# EAGLE schematic Resistor_Resistor (EAGLE 8.3.0), part 9 of 43
## Parts (continued)
R11658  10K  RESISTOR_0201  [0201]
R11659  10K  RESISTOR_0201  [0201]
R11660  10K  RESISTOR_0201  [0201]
R11661  10K  RESISTOR_0201  [0201]
R11662  10K  RESISTOR_0201  [0201]
R11663  10K  RESISTOR_0201  [0201]
R11664  10K  RESISTOR_0201  [0201]
R11665  10K  RESISTOR_0201  [0201]
R11666  10K  RESISTOR_0201  [0201]
R11667  10K  RESISTOR_0201  [0201]
R11668  10K  RESISTOR_0201  [0201]
R11669  10K  RESISTOR_0201  [0201]
R11670  10K  RESISTOR_0201  [0201]
R11671  10K  RESISTOR_0201  [0201]
R11672  10K  RESISTOR_0201  [0201]
R11673  10K  RESISTOR_0201  [0201]
R11674  10K  RESISTOR_0201  [0201]
R11675  10K  RESISTOR_0201  [0201]
R11676  10K  RESISTOR_0201  [0201]
R11677  10K  RESISTOR_0201  [0201]
R11678  10K  RESISTOR_0201  [0201]
R11679  10K  RESISTOR_0201  [0201]
R11680  10K  RESISTOR_0201  [0201]
R11681  10K  RESISTOR_0201  [0201]
R11682  10K  RESISTOR_0201  [0201]
R11683  10K  RESISTOR_0201  [0201]
R11684  10K  RESISTOR_0201  [0201]
R11685  10K  RESISTOR_0201  [0201]
R11686  10K  RESISTOR_0201  [0201]
R11687  10K  RESISTOR_0201  [0201]
R11688  10K  RESISTOR_0201  [0201]
R11689  10K  RESISTOR_0201  [0201]
R11690  10K  RESISTOR_0201  [0201]
R11691  10K  RESISTOR_0201  [0201]
R11692  10K  RESISTOR_0201  [0201]
R11693  10K  RESISTOR_0201  [0201]
R11694  10K  RESISTOR_0201  [0201]
R11695  10K  RESISTOR_0201  [0201]
R11696  10K  RESISTOR_0201  [0201]
R11697  10K  RESISTOR_0201  [0201]
R11698  10K  RESISTOR_0201  [0201]
R11699  10K  RESISTOR_0201  [0201]
R11700  10K  RESISTOR_0201  [0201]
R11701  10K  RESISTOR_0201  [0201]
R11702  10K  RESISTOR_0201  [0201]
R11703  10K  RESISTOR_0201  [0201]
R11704  10K  RESISTOR_0201  [0201]
R11705  10K  RESISTOR_0201  [0201]
R11706  10K  RESISTOR_0201  [0201]
R11707  10K  RESISTOR_0201  [0201]
R11708  10K  RESISTOR_0201  [0201]
R11709  10K  RESISTOR_0201  [0201]
R11710  10K  RESISTOR_0201  [0201]
R11711  10K  RESISTOR_0201  [0201]
R11712  10K  RESISTOR_0201  [0201]
R11713  10K  RESISTOR_0201  [0201]
R11714  10K  RESISTOR_0201  [0201]
R11715  10K  RESISTOR_0201  [0201]
R11716  10K  RESISTOR_0201  [0201]
R11717  10K  RESISTOR_0201  [0201]
R11718  10K  RESISTOR_0201  [0201]
R11719  10K  RESISTOR_0201  [0201]
R11720  10K  RESISTOR_0201  [0201]
R11721  10K  RESISTOR_0201  [0201]
R11722  10K  RESISTOR_0201  [0201]
R11723  10K  RESISTOR_0201  [0201]
R11724  10K  RESISTOR_0201  [0201]
R11725  10K  RESISTOR_0201  [0201]
R11726  10K  RESISTOR_0201  [0201]
R11727  10K  RESISTOR_0201  [0201]
R11728  10K  RESISTOR_0201  [0201]
R11729  10K  RESISTOR_0201  [0201]
R11730  10K  RESISTOR_0201  [0201]
R11731  10K  RESISTOR_0201  [0201]
R11732  10K  RESISTOR_0201  [0201]
R11733  10K  RESISTOR_0201  [0201]
R11734  10K  RESISTOR_0201  [0201]
R11735  10K  RESISTOR_0201  [0201]
R11736  10K  RESISTOR_0201  [0201]
R11737  10K  RESISTOR_0201  [0201]
R11738  10K  RESISTOR_0201  [0201]
R11739  10K  RESISTOR_0201  [0201]
R11740  10K  RESISTOR_0201  [0201]
R11741  10K  RESISTOR_0201  [0201]
R11742  10K  RESISTOR_0201  [0201]
R11743  10K  RESISTOR_0201  [0201]
R11744  10K  RESISTOR_0201  [0201]
R11745  10K  RESISTOR_0201  [0201]
R11746  10K  RESISTOR_0201  [0201]
R11747  10K  RESISTOR_0201  [0201]
R11748  10K  RESISTOR_0201  [0201]
R11749  10K  RESISTOR_0201  [0201]
R11750  10K  RESISTOR_0201  [0201]
R11751  10K  RESISTOR_0201  [0201]
R11752  10K  RESISTOR_0201  [0201]
R11753  10K  RESISTOR_0201  [0201]
R11754  10K  RESISTOR_0201  [0201]
R11755  10K  RESISTOR_0201  [0201]
R11756  10K  RESISTOR_0201  [0201]
R11757  10K  RESISTOR_0201  [0201]
R11758  10K  RESISTOR_0201  [0201]
R11759  10K  RESISTOR_0201  [0201]
R11760  10K  RESISTOR_0201  [0201]
R11761  10K  RESISTOR_0201  [0201]
R11762  10K  RESISTOR_0201  [0201]
R11763  10K  RESISTOR_0201  [0201]
R11764  10K  RESISTOR_0201  [0201]
R11765  10K  RESISTOR_0201  [0201]
R11766  10K  RESISTOR_0201  [0201]
R11767  10K  RESISTOR_0201  [0201]
R11768  10K  RESISTOR_0201  [0201]
R11769  10K  RESISTOR_0201  [0201]
R11770  10K  RESISTOR_0201  [0201]
R11771  10K  RESISTOR_0201  [0201]
R11772  10K  RESISTOR_0201  [0201]
R11773  10K  RESISTOR_0201  [0201]
R11774  10K  RESISTOR_0201  [0201]
R11775  10K  RESISTOR_0201  [0201]
R11776  10K  RESISTOR_0201  [0201]
R11777  10K  RESISTOR_0201  [0201]
R11778  10K  RESISTOR_0201  [0201]
R11779  10K  RESISTOR_0201  [0201]
R11780  10K  RESISTOR_0201  [0201]
R11781  10K  RESISTOR_0201  [0201]
R11782  10K  RESISTOR_0201  [0201]
R11783  10K  RESISTOR_0201  [0201]
R11784  10K  RESISTOR_0201  [0201]
R11785  10K  RESISTOR_0201  [0201]
R11786  10K  RESISTOR_0201  [0201]
R11787  10K  RESISTOR_0201  [0201]
R11788  10K  RESISTOR_0201  [0201]
R11789  10K  RESISTOR_0201  [0201]
R11790  10K  RESISTOR_0201  [0201]
R11791  10K  RESISTOR_0201  [0201]
R11792  10K  RESISTOR_0201  [0201]
R11793  10K  RESISTOR_0201  [0201]
R11794  10K  RESISTOR_0201  [0201]
R11795  10K  RESISTOR_0201  [0201]
R11796  10K  RESISTOR_0201  [0201]
R11797  10K  RESISTOR_0201  [0201]
R11798  10K  RESISTOR_0201  [0201]
R11799  10K  RESISTOR_0201  [0201]
R11800  10K  RESISTOR_0201  [0201]
R11801  10K  RESISTOR_0201  [0201]
R11802  10K  RESISTOR_0201  [0201]
R11803  10K  RESISTOR_0201  [0201]
R11804  10K  RESISTOR_0201  [0201]
R11805  10K  RESISTOR_0201  [0201]
R11806  10K  RESISTOR_0201  [0201]
R11807  10K  RESISTOR_0201  [0201]
R11808  10K  RESISTOR_0201  [0201]
R11809  10K  RESISTOR_0201  [0201]
R11810  10K  RESISTOR_0201  [0201]
R11811  10K  RESISTOR_0201  [0201]
R11812  10K  RESISTOR_0201  [0201]
R11813  10K  RESISTOR_0201  [0201]
R11814  10K  RESISTOR_0201  [0201]
R11815  10K  RESISTOR_0201  [0201]
R11816  10K  RESISTOR_0201  [0201]
R11817  10K  RESISTOR_0201  [0201]
R11818  10K  RESISTOR_0201  [0201]
R11819  10K  RESISTOR_0201  [0201]
R11820  10K  RESISTOR_0201  [0201]
R11821  10K  RESISTOR_0201  [0201]
R11822  10K  RESISTOR_0201  [0201]
R11823  10K  RESISTOR_0201  [0201]
R11824  10K  RESISTOR_0201  [0201]
R11825  10K  RESISTOR_0201  [0201]
R11826  10K  RESISTOR_0201  [0201]
R11827  10K  RESISTOR_0201  [0201]
R11828  10K  RESISTOR_0201  [0201]
R11829  10K  RESISTOR_0201  [0201]
R11830  10K  RESISTOR_0201  [0201]
R11831  10K  RESISTOR_0201  [0201]
R11832  10K  RESISTOR_0201  [0201]
R11833  10K  RESISTOR_0201  [0201]
R11834  10K  RESISTOR_0201  [0201]
R11835  10K  RESISTOR_0201  [0201]
R11836  10K  RESISTOR_0201  [0201]
R11837  10K  RESISTOR_0201  [0201]
R11838  10K  RESISTOR_0201  [0201]
R11839  10K  RESISTOR_0201  [0201]
R11840  10K  RESISTOR_0201  [0201]
R11841  10K  RESISTOR_0201  [0201]
R11842  10K  RESISTOR_0201  [0201]
R11843  10K  RESISTOR_0201  [0201]
R11844  10K  RESISTOR_0201  [0201]
R11845  10K  RESISTOR_0201  [0201]
R11846  10K  RESISTOR_0201  [0201]
R11847  10K  RESISTOR_0201  [0201]
R11848  10K  RESISTOR_0201  [0201]
R11849  10K  RESISTOR_0201  [0201]
R11850  10K  RESISTOR_0201  [0201]
R11851  10K  RESISTOR_0201  [0201]
R11852  10K  RESISTOR_0201  [0201]
R11853  10K  RESISTOR_0201  [0201]
R11854  10K  RESISTOR_0201  [0201]
R11855  10K  RESISTOR_0201  [0201]
R11856  10K  RESISTOR_0201  [0201]
R11857  10K  RESISTOR_0201  [0201]
R11858  10K  RESISTOR_0201  [0201]
R11859  10K  RESISTOR_0201  [0201]
R11860  10K  RESISTOR_0201  [0201]
R11861  10K  RESISTOR_0201  [0201]
R11862  10K  RESISTOR_0201  [0201]
R11863  10K  RESISTOR_0201  [0201]
R11864  10K  RESISTOR_0201  [0201]
R11865  10K  RESISTOR_0201  [0201]
R11866  10K  RESISTOR_0201  [0201]
R11867  10K  RESISTOR_0201  [0201]
R11868  10K  RESISTOR_0201  [0201]
R11869  10K  RESISTOR_0201  [0201]
R11870  10K  RESISTOR_0201  [0201]
R11871  10K  RESISTOR_0201  [0201]
R11872  10K  RESISTOR_0201  [0201]
R11873  10K  RESISTOR_0201  [0201]
R11874  10K  RESISTOR_0201  [0201]
R11875  10K  RESISTOR_0201  [0201]
R11876  10K  RESISTOR_0201  [0201]
R11877  10K  RESISTOR_0201  [0201]
R11878  10K  RESISTOR_0201  [0201]
R11879  10K  RESISTOR_0201  [0201]
R11880  10K  RESISTOR_0201  [0201]
R11881  10K  RESISTOR_0201  [0201]
R11882  10K  RESISTOR_0201  [0201]
R11883  10K  RESISTOR_0201  [0201]
R11884  10K  RESISTOR_0201  [0201]
R11885  10K  RESISTOR_0201  [0201]
R11886  10K  RESISTOR_0201  [0201]
R11887  10K  RESISTOR_0201  [0201]
R11888  10K  RESISTOR_0201  [0201]
R11889  10K  RESISTOR_0201  [0201]
R11890  10K  RESISTOR_0201  [0201]
R11891  10K  RESISTOR_0201  [0201]
R11892  10K  RESISTOR_0201  [0201]
R11893  10K  RESISTOR_0201  [0201]
R11894  10K  RESISTOR_0201  [0201]
R11895  10K  RESISTOR_0201  [0201]
R11896  10K  RESISTOR_0201  [0201]
R11897  10K  RESISTOR_0201  [0201]
R11898  10K  RESISTOR_0201  [0201]
R11899  10K  RESISTOR_0201  [0201]
R11900  10K  RESISTOR_0201  [0201]
R11901  10K  RESISTOR_0201  [0201]
R11902  10K  RESISTOR_0201  [0201]
R11903  10K  RESISTOR_0201  [0201]
R11904  10K  RESISTOR_0201  [0201]
R11905  10K  RESISTOR_0201  [0201]
R11906  10K  RESISTOR_0201  [0201]
R11907  10K  RESISTOR_0201  [0201]
R11908  10K  RESISTOR_0201  [0201]
R11909  10K  RESISTOR_0201  [0201]
R11910  10K  RESISTOR_0201  [0201]
R11911  10K  RESISTOR_0201  [0201]
R11912  10K  RESISTOR_0201  [0201]
R11913  10K  RESISTOR_0201  [0201]
R11914  10K  RESISTOR_0201  [0201]
R11915  10K  RESISTOR_0201  [0201]
R11916  10K  RESISTOR_0201  [0201]
R11917  10K  RESISTOR_0201  [0201]
R11918  10K  RESISTOR_0201  [0201]
R11919  10K  RESISTOR_0201  [0201]
R11920  10K  RESISTOR_0201  [0201]
R11921  10K  RESISTOR_0201  [0201]
R11922  10K  RESISTOR_0201  [0201]
R11923  10K  RESISTOR_0201  [0201]
R11924  10K  RESISTOR_0201  [0201]
R11925  10K  RESISTOR_0201  [0201]
R11926  10K  RESISTOR_0201  [0201]
R11927  10K  RESISTOR_0201  [0201]
R11928  10K  RESISTOR_0201  [0201]
R11929  10K  RESISTOR_0201  [0201]
R11930  10K  RESISTOR_0201  [0201]
R11931  10K  RESISTOR_0201  [0201]
R11932  10K  RESISTOR_0201  [0201]
R11933  10K  RESISTOR_0201  [0201]
R11934  10K  RESISTOR_0201  [0201]
R11935  10K  RESISTOR_0201  [0201]
R11936  10K  RESISTOR_0201  [0201]
R11937  10K  RESISTOR_0201  [0201]
R11938  10K  RESISTOR_0201  [0201]
R11939  10K  RESISTOR_0201  [0201]
R11940  10K  RESISTOR_0201  [0201]
R11941  10K  RESISTOR_0201  [0201]
R11942  10K  RESISTOR_0201  [0201]
R11943  10K  RESISTOR_0201  [0201]
R11944  10K  RESISTOR_0201  [0201]
R11945  10K  RESISTOR_0201  [0201]
R11946  10K  RESISTOR_0201  [0201]
R11947  10K  RESISTOR_0201  [0201]
R11948  10K  RESISTOR_0201  [0201]
R11949  10K  RESISTOR_0201  [0201]
R11950  10K  RESISTOR_0201  [0201]
R11951  10K  RESISTOR_0201  [0201]
R11952  10K  RESISTOR_0201  [0201]
R11953  10K  RESISTOR_0201  [0201]
R11954  10K  RESISTOR_0201  [0201]
R11955  10K  RESISTOR_0201  [0201]
R11956  10K  RESISTOR_0201  [0201]
R11957  10K  RESISTOR_0201  [0201]
R11958  10K  RESISTOR_0201  [0201]
R11959  10K  RESISTOR_0201  [0201]
R11960  10K  RESISTOR_0201  [0201]
R11961  10K  RESISTOR_0201  [0201]
R11962  10K  RESISTOR_0201  [0201]
R11963  10K  RESISTOR_0201  [0201]
R11964  10K  RESISTOR_0201  [0201]
R11965  10K  RESISTOR_0201  [0201]
R11966  10K  RESISTOR_0201  [0201]
R11967  10K  RESISTOR_0201  [0201]
R11968  10K  RESISTOR_0201  [0201]
R11969  10K  RESISTOR_0201  [0201]
R11970  10K  RESISTOR_0201  [0201]
R11971  10K  RESISTOR_0201  [0201]
R11972  10K  RESISTOR_0201  [0201]
R11973  10K  RESISTOR_0201  [0201]
R11974  10K  RESISTOR_0201  [0201]
R11975  10K  RESISTOR_0201  [0201]
R11976  10K  RESISTOR_0201  [0201]
R11977  10K  RESISTOR_0201  [0201]
R11978  10K  RESISTOR_0201  [0201]
R11979  10K  RESISTOR_0201  [0201]
R11980  10K  RESISTOR_0201  [0201]
R11981  10K  RESISTOR_0201  [0201]
R11982  10K  RESISTOR_0201  [0201]
R11983  10K  RESISTOR_0201  [0201]
R11984  10K  RESISTOR_0201  [0201]
R11985  10K  RESISTOR_0201  [0201]
R11986  10K  RESISTOR_0201  [0201]
R11987  10K  RESISTOR_0201  [0201]
R11988  10K  RESISTOR_0201  [0201]
R11989  10K  RESISTOR_0201  [0201]
R11990  10K  RESISTOR_0201  [0201]
R11991  10K  RESISTOR_0201  [0201]
R11992  10K  RESISTOR_0201  [0201]
R11993  10K  RESISTOR_0201  [0201]
R11994  10K  RESISTOR_0201  [0201]
R11995  10K  RESISTOR_0201  [0201]
R11996  10K  RESISTOR_0201  [0201]
R11997  10K  RESISTOR_0201  [0201]
R11998  10K  RESISTOR_0201  [0201]
R11999  10K  RESISTOR_0201  [0201]
R12000  10K  RESISTOR_0201  [0201]
R12001  10K  RESISTOR_0201  [0201]
R12002  10K  RESISTOR_0201  [0201]
R12003  10K  RESISTOR_0201  [0201]
R12004  10K  RESISTOR_0201  [0201]
R12005  10K  RESISTOR_0201  [0201]
R12006  10K  RESISTOR_0201  [0201]
R12007  10K  RESISTOR_0201  [0201]
R12008  10K  RESISTOR_0201  [0201]
R12009  10K  RESISTOR_0201  [0201]
R12010  10K  RESISTOR_0201  [0201]
R12011  10K  RESISTOR_0201  [0201]
R12012  10K  RESISTOR_0201  [0201]
R12013  10K  RESISTOR_0201  [0201]
R12014  10K  RESISTOR_0201  [0201]
R12015  10K  RESISTOR_0201  [0201]
R12016  10K  RESISTOR_0201  [0201]
R12017  10K  RESISTOR_0201  [0201]
R12018  10K  RESISTOR_0201  [0201]
R12019  10K  RESISTOR_0201  [0201]
R12020  10K  RESISTOR_0201  [0201]
R12021  10K  RESISTOR_0201  [0201]
R12022  10K  RESISTOR_0201  [0201]
R12023  10K  RESISTOR_0201  [0201]
R12024  10K  RESISTOR_0201  [0201]
R12025  10K  RESISTOR_0201  [0201]
R12026  10K  RESISTOR_0201  [0201]
R12027  10K  RESISTOR_0201  [0201]
R12028  10K  RESISTOR_0201  [0201]
R12029  10K  RESISTOR_0201  [0201]
R12030  10K  RESISTOR_0201  [0201]
R12031  10K  RESISTOR_0201  [0201]
R12032  10K  RESISTOR_0201  [0201]
R12033  10K  RESISTOR_0201  [0201]
R12034  10K  RESISTOR_0201  [0201]
R12035  10K  RESISTOR_0201  [0201]
R12036  10K  RESISTOR_0201  [0201]
R12037  10K  RESISTOR_0201  [0201]
R12038  10K  RESISTOR_0201  [0201]
R12039  10K  RESISTOR_0201  [0201]
R12040  10K  RESISTOR_0201  [0201]
R12041  10K  RESISTOR_0201  [0201]
R12042  10K  RESISTOR_0201  [0201]
R12043  10K  RESISTOR_0201  [0201]
R12044  10K  RESISTOR_0201  [0201]
R12045  10K  RESISTOR_0201  [0201]
R12046  10K  RESISTOR_0201  [0201]
R12047  10K  RESISTOR_0201  [0201]
R12048  10K  RESISTOR_0201  [0201]
R12049  10K  RESISTOR_0201  [0201]
R12050  10K  RESISTOR_0201  [0201]
R12051  10K  RESISTOR_0201  [0201]
R12052  10K  RESISTOR_0201  [0201]
R12053  10K  RESISTOR_0201  [0201]
R12054  10K  RESISTOR_0201  [0201]
R12055  10K  RESISTOR_0201  [0201]
R12056  10K  RESISTOR_0201  [0201]
R12057  10K  RESISTOR_0201  [0201]
R12058  10K  RESISTOR_0201  [0201]
R12059  10K  RESISTOR_0201  [0201]
R12060  10K  RESISTOR_0201  [0201]
R12061  10K  RESISTOR_0201  [0201]
R12062  10K  RESISTOR_0201  [0201]
R12063  10K  RESISTOR_0201  [0201]
R12064  10K  RESISTOR_0201  [0201]
R12065  10K  RESISTOR_0201  [0201]
R12066  10K  RESISTOR_0201  [0201]
R12067  10K  RESISTOR_0201  [0201]
R12068  10K  RESISTOR_0201  [0201]
R12069  10K  RESISTOR_0201  [0201]
R12070  10K  RESISTOR_0201  [0201]
R12071  10K  RESISTOR_0201  [0201]
R12072  10K  RESISTOR_0201  [0201]
R12073  10K  RESISTOR_0201  [0201]
R12074  10K  RESISTOR_0201  [0201]
R12075  10K  RESISTOR_0201  [0201]
R12076  10K  RESISTOR_0201  [0201]
R12077  10K  RESISTOR_0201  [0201]
R12078  10K  RESISTOR_0201  [0201]
R12079  10K  RESISTOR_0201  [0201]
R12080  10K  RESISTOR_0201  [0201]
R12081  10K  RESISTOR_0201  [0201]
R12082  10K  RESISTOR_0201  [0201]
R12083  10K  RESISTOR_0201  [0201]
R12084  10K  RESISTOR_0201  [0201]
R12085  10K  RESISTOR_0201  [0201]
R12086  10K  RESISTOR_0201  [0201]
R12087  10K  RESISTOR_0201  [0201]
R12088  10K  RESISTOR_0201  [0201]
R12089  10K  RESISTOR_0201  [0201]
R12090  10K  RESISTOR_0201  [0201]
R12091  10K  RESISTOR_0201  [0201]
R12092  10K  RESISTOR_0201  [0201]
R12093  10K  RESISTOR_0201  [0201]
R12094  10K  RESISTOR_0201  [0201]
R12095  10K  RESISTOR_0201  [0201]
R12096  10K  RESISTOR_0201  [0201]
R12097  10K  RESISTOR_0201  [0201]
R12098  10K  RESISTOR_0201  [0201]
R12099  10K  RESISTOR_0201  [0201]
R12100  10K  RESISTOR_0201  [0201]
R12101  10K  RESISTOR_0201  [0201]
R12102  10K  RESISTOR_0201  [0201]
R12103  10K  RESISTOR_0201  [0201]
R12104  10K  RESISTOR_0201  [0201]
R12105  10K  RESISTOR_0201  [0201]
R12106  10K  RESISTOR_0201  [0201]
R12107  10K  RESISTOR_0201  [0201]
R12108  10K  RESISTOR_0201  [0201]
R12109  10K  RESISTOR_0201  [0201]
R12110  10K  RESISTOR_0201  [0201]
R12111  10K  RESISTOR_0201  [0201]
R12112  10K  RESISTOR_0201  [0201]
R12113  10K  RESISTOR_0201  [0201]
R12114  10K  RESISTOR_0201  [0201]
R12115  10K  RESISTOR_0201  [0201]
R12116  10K  RESISTOR_0201  [0201]
R12117  10K  RESISTOR_0201  [0201]
R12118  10K  RESISTOR_0201  [0201]
R12119  10K  RESISTOR_0201  [0201]
R12120  10K  RESISTOR_0201  [0201]
R12121  10K  RESISTOR_0201  [0201]
R12122  10K  RESISTOR_0201  [0201]
R12123  10K  RESISTOR_0201  [0201]
R12124  10K  RESISTOR_0201  [0201]
R12125  10K  RESISTOR_0201  [0201]
R12126  10K  RESISTOR_0201  [0201]
R12127  10K  RESISTOR_0201  [0201]
R12128  10K  RESISTOR_0201  [0201]
R12129  10K  RESISTOR_0201  [0201]
R12130  10K  RESISTOR_0201  [0201]
R12131  10K  RESISTOR_0201  [0201]
R12132  10K  RESISTOR_0201  [0201]
R12133  10K  RESISTOR_0201  [0201]
R12134  10K  RESISTOR_0201  [0201]
R12135  10K  RESISTOR_0201  [0201]
R12136  10K  RESISTOR_0201  [0201]
R12137  10K  RESISTOR_0201  [0201]
R12138  10K  RESISTOR_0201  [0201]
R12139  10K  RESISTOR_0201  [0201]
R12140  10K  RESISTOR_0201  [0201]
R12141  10K  RESISTOR_0201  [0201]
R12142  10K  RESISTOR_0201  [0201]
R12143  10K  RESISTOR_0201  [0201]
R12144  10K  RESISTOR_0201  [0201]
R12145  10K  RESISTOR_0201  [0201]
R12146  10K  RESISTOR_0201  [0201]
R12147  10K  RESISTOR_0201  [0201]
R12148  10K  RESISTOR_0201  [0201]
R12149  10K  RESISTOR_0201  [0201]
R12150  10K  RESISTOR_0201  [0201]
R12151  10K  RESISTOR_0201  [0201]
R12152  10K  RESISTOR_0201  [0201]
R12153  10K  RESISTOR_0201  [0201]
R12154  10K  RESISTOR_0201  [0201]
R12155  10K  RESISTOR_0201  [0201]
R12156  10K  RESISTOR_0201  [0201]
R12157  10K  RESISTOR_0201  [0201]
R12158  10K  RESISTOR_0201  [0201]
R12159  10K  RESISTOR_0201  [0201]
R12160  10K  RESISTOR_0201  [0201]
R12161  10K  RESISTOR_0201  [0201]
R12162  10K  RESISTOR_0201  [0201]
R12163  10K  RESISTOR_0201  [0201]
R12164  10K  RESISTOR_0201  [0201]
R12165  10K  RESISTOR_0201  [0201]
R12166  10K  RESISTOR_0201  [0201]
R12167  10K  RESISTOR_0201  [0201]
R12168  10K  RESISTOR_0201  [0201]
R12169  10K  RESISTOR_0201  [0201]
R12170  10K  RESISTOR_0201  [0201]
R12171  10K  RESISTOR_0201  [0201]
R12172  10K  RESISTOR_0201  [0201]
R12173  10K  RESISTOR_0201  [0201]
R12174  10K  RESISTOR_0201  [0201]
R12175  10K  RESISTOR_0201  [0201]
R12176  10K  RESISTOR_0201  [0201]
R12177  10K  RESISTOR_0201  [0201]
R12178  10K  RESISTOR_0201  [0201]
R12179  10K  RESISTOR_0201  [0201]
R12180  10K  RESISTOR_0201  [0201]
R12181  10K  RESISTOR_0201  [0201]
R12182  10K  RESISTOR_0201  [0201]
R12183  10K  RESISTOR_0201  [0201]
R12184  10K  RESISTOR_0201  [0201]
R12185  10K  RESISTOR_0201  [0201]
R12186  10K  RESISTOR_0201  [0201]
R12187  10K  RESISTOR_0201  [0201]
R12188  10K  RESISTOR_0201  [0201]
R12189  10K  RESISTOR_0201  [0201]
R12190  10K  RESISTOR_0201  [0201]
R12191  10K  RESISTOR_0201  [0201]
R12192  10K  RESISTOR_0201  [0201]
R12193  10K  RESISTOR_0201  [0201]
R12194  10K  RESISTOR_0201  [0201]
R12195  10K  RESISTOR_0201  [0201]
R12196  10K  RESISTOR_0201  [0201]
R12197  10K  RESISTOR_0201  [0201]
R12198  10K  RESISTOR_0201  [0201]
R12199  10K  RESISTOR_0201  [0201]
R12200  10K  RESISTOR_0201  [0201]
R12201  10K  RESISTOR_0201  [0201]
R12202  10K  RESISTOR_0201  [0201]
R12203  10K  RESISTOR_0201  [0201]
R12204  10K  RESISTOR_0201  [0201]
R12205  10K  RESISTOR_0201  [0201]
R12206  10K  RESISTOR_0201  [0201]
R12207  10K  RESISTOR_0201  [0201]
R12208  10K  RESISTOR_0201  [0201]
R12209  10K  RESISTOR_0201  [0201]
R12210  10K  RESISTOR_0201  [0201]
R12211  10K  RESISTOR_0201  [0201]
R12212  10K  RESISTOR_0201  [0201]
R12213  10K  RESISTOR_0201  [0201]
R12214  10K  RESISTOR_0201  [0201]
R12215  10K  RESISTOR_0201  [0201]
R12216  10K  RESISTOR_0201  [0201]
R12217  10K  RESISTOR_0201  [0201]
R12218  10K  RESISTOR_0201  [0201]
R12219  10K  RESISTOR_0201  [0201]
R12220  10K  RESISTOR_0201  [0201]
R12221  10K  RESISTOR_0201  [0201]
R12222  10K  RESISTOR_0201  [0201]
R12223  10K  RESISTOR_0201  [0201]
R12224  10K  RESISTOR_0201  [0201]
R12225  10K  RESISTOR_0201  [0201]
R12226  10K  RESISTOR_0201  [0201]
R12227  10K  RESISTOR_0201  [0201]
R12228  10K  RESISTOR_0201  [0201]
R12229  10K  RESISTOR_0201  [0201]
R12230  10K  RESISTOR_0201  [0201]
R12231  10K  RESISTOR_0201  [0201]
R12232  10K  RESISTOR_0201  [0201]
R12233  10K  RESISTOR_0201  [0201]
R12234  10K  RESISTOR_0201  [0201]
R12235  10K  RESISTOR_0201  [0201]
R12236  10K  RESISTOR_0201  [0201]
R12237  10K  RESISTOR_0201  [0201]
R12238  10K  RESISTOR_0201  [0201]
R12239  10K  RESISTOR_0201  [0201]
R12240  10K  RESISTOR_0201  [0201]
R12241  10K  RESISTOR_0201  [0201]
R12242  10K  RESISTOR_0201  [0201]
R12243  10K  RESISTOR_0201  [0201]
R12244  10K  RESISTOR_0201  [0201]
R12245  10K  RESISTOR_0201  [0201]
R12246  10K  RESISTOR_0201  [0201]
R12247  10K  RESISTOR_0201  [0201]
R12248  10K  RESISTOR_0201  [0201]
R12249  10K  RESISTOR_0201  [0201]
R12250  10K  RESISTOR_0201  [0201]
R12251  10K  RESISTOR_0201  [0201]
R12252  10K  RESISTOR_0201  [0201]
R12253  10K  RESISTOR_0201  [0201]
R12254  10K  RESISTOR_0201  [0201]
R12255  10K  RESISTOR_0201  [0201]
R12256  10K  RESISTOR_0201  [0201]
R12257  10K  RESISTOR_0201  [0201]
R12258  10K  RESISTOR_0201  [0201]
R12259  10K  RESISTOR_0201  [0201]
R12260  10K  RESISTOR_0201  [0201]
R12261  10K  RESISTOR_0201  [0201]
R12262  10K  RESISTOR_0201  [0201]
R12263  10K  RESISTOR_0201  [0201]
R12264  10K  RESISTOR_0201  [0201]
R12265  10K  RESISTOR_0201  [0201]
R12266  10K  RESISTOR_0201  [0201]
R12267  10K  RESISTOR_0201  [0201]
R12268  10K  RESISTOR_0201  [0201]
R12269  10K  RESISTOR_0201  [0201]
R12270  10K  RESISTOR_0201  [0201]
R12271  10K  RESISTOR_0201  [0201]
R12272  10K  RESISTOR_0201  [0201]
R12273  10K  RESISTOR_0201  [0201]
R12274  10K  RESISTOR_0201  [0201]
R12275  10K  RESISTOR_0201  [0201]
R12276  10K  RESISTOR_0201  [0201]
R12277  10K  RESISTOR_0201  [0201]
R12278  10K  RESISTOR_0201  [0201]
R12279  10K  RESISTOR_0201  [0201]
R12280  10K  RESISTOR_0201  [0201]
R12281  10K  RESISTOR_0201  [0201]
R12282  10K  RESISTOR_0201  [0201]
R12283  10K  RESISTOR_0201  [0201]
R12284  10K  RESISTOR_0201  [0201]
R12285  10K  RESISTOR_0201  [0201]
R12286  10K  RESISTOR_0201  [0201]
R12287  10K  RESISTOR_0201  [0201]
R12288  10K  RESISTOR_0201  [0201]
R12289  10K  RESISTOR_0201  [0201]
R12290  10K  RESISTOR_0201  [0201]
R12291  10K  RESISTOR_0201  [0201]
R12292  10K  RESISTOR_0201  [0201]
R12293  10K  RESISTOR_0201  [0201]
R12294  10K  RESISTOR_0201  [0201]
R12295  10K  RESISTOR_0201  [0201]
R12296  10K  RESISTOR_0201  [0201]
R12297  10K  RESISTOR_0201  [0201]
R12298  10K  RESISTOR_0201  [0201]
R12299  10K  RESISTOR_0201  [0201]
R12300  10K  RESISTOR_0201  [0201]
R12301  10K  RESISTOR_0201  [0201]
R12302  10K  RESISTOR_0201  [0201]
R12303  10K  RESISTOR_0201  [0201]
R12304  10K  RESISTOR_0201  [0201]
R12305  10K  RESISTOR_0201  [0201]
R12306  10K  RESISTOR_0201  [0201]
R12307  10K  RESISTOR_0201  [0201]
R12308  10K  RESISTOR_0201  [0201]
R12309  10K  RESISTOR_0201  [0201]
R12310  10K  RESISTOR_0201  [0201]
R12311  10K  RESISTOR_0201  [0201]
R12312  10K  RESISTOR_0201  [0201]
R12313  10K  RESISTOR_0201  [0201]
R12314  10K  RESISTOR_0201  [0201]
R12315  10K  RESISTOR_0201  [0201]
R12316  10K  RESISTOR_0201  [0201]
R12317  10K  RESISTOR_0201  [0201]
R12318  10K  RESISTOR_0201  [0201]
R12319  10K  RESISTOR_0201  [0201]
R12320  10K  RESISTOR_0201  [0201]
R12321  10K  RESISTOR_0201  [0201]
R12322  10K  RESISTOR_0201  [0201]
R12323  10K  RESISTOR_0201  [0201]
R12324  10K  RESISTOR_0201  [0201]
R12325  10K  RESISTOR_0201  [0201]
R12326  10K  RESISTOR_0201  [0201]
R12327  10K  RESISTOR_0201  [0201]
R12328  10K  RESISTOR_0201  [0201]
R12329  10K  RESISTOR_0201  [0201]
R12330  10K  RESISTOR_0201  [0201]
R12331  10K  RESISTOR_0201  [0201]
R12332  10K  RESISTOR_0201  [0201]
R12333  10K  RESISTOR_0201  [0201]
R12334  10K  RESISTOR_0201  [0201]
R12335  10K  RESISTOR_0201  [0201]
R12336  10K  RESISTOR_0201  [0201]
R12337  10K  RESISTOR_0201  [0201]
R12338  10K  RESISTOR_0201  [0201]
R12339  10K  RESISTOR_0201  [0201]
R12340  10K  RESISTOR_0201  [0201]
R12341  10K  RESISTOR_0201  [0201]
R12342  10K  RESISTOR_0201  [0201]
R12343  10K  RESISTOR_0201  [0201]
R12344  10K  RESISTOR_0201  [0201]
R12345  10K  RESISTOR_0201  [0201]
R12346  10K  RESISTOR_0201  [0201]
R12347  10K  RESISTOR_0201  [0201]
R12348  10K  RESISTOR_0201  [0201]
R12349  10K  RESISTOR_0201  [0201]
R12350  10K  RESISTOR_0201  [0201]
R12351  10K  RESISTOR_0201  [0201]
R12352  10K  RESISTOR_0201  [0201]
R12353  10K  RESISTOR_0201  [0201]
R12354  10K  RESISTOR_0201  [0201]
R12355  10K  RESISTOR_0201  [0201]
R12356  10K  RESISTOR_0201  [0201]
R12357  10K  RESISTOR_0201  [0201]
R12358  10K  RESISTOR_0201  [0201]
R12359  10K  RESISTOR_0201  [0201]
R12360  10K  RESISTOR_0201  [0201]
R12361  10K  RESISTOR_0201  [0201]
R12362  10K  RESISTOR_0201  [0201]
R12363  10K  RESISTOR_0201  [0201]
R12364  10K  RESISTOR_0201  [0201]
R12365  10K  RESISTOR_0201  [0201]
R12366  10K  RESISTOR_0201  [0201]
R12367  10K  RESISTOR_0201  [0201]
R12368  10K  RESISTOR_0201  [0201]
R12369  10K  RESISTOR_0201  [0201]
R12370  10K  RESISTOR_0201  [0201]
R12371  10K  RESISTOR_0201  [0201]
R12372  10K  RESISTOR_0201  [0201]
R12373  10K  RESISTOR_0201  [0201]
R12374  10K  RESISTOR_0201  [0201]
R12375  10K  RESISTOR_0201  [0201]
R12376  10K  RESISTOR_0201  [0201]
R12377  10K  RESISTOR_0201  [0201]
R12378  10K  RESISTOR_0201  [0201]
R12379  10K  RESISTOR_0201  [0201]
R12380  10K  RESISTOR_0201  [0201]
R12381  10K  RESISTOR_0201  [0201]
R12382  10K  RESISTOR_0201  [0201]
R12383  10K  RESISTOR_0201  [0201]
R12384  10K  RESISTOR_0201  [0201]
R12385  10K  RESISTOR_0201  [0201]
R12386  10K  RESISTOR_0201  [0201]
R12387  10K  RESISTOR_0201  [0201]
R12388  10K  RESISTOR_0201  [0201]
R12389  10K  RESISTOR_0201  [0201]
R12390  10K  RESISTOR_0201  [0201]
R12391  10K  RESISTOR_0201  [0201]
R12392  10K  RESISTOR_0201  [0201]
R12393  10K  RESISTOR_0201  [0201]
R12394  10K  RESISTOR_0201  [0201]
R12395  10K  RESISTOR_0201  [0201]
R12396  10K  RESISTOR_0201  [0201]
R12397  10K  RESISTOR_0201  [0201]
R12398  10K  RESISTOR_0201  [0201]
R12399  10K  RESISTOR_0201  [0201]
R12400  10K  RESISTOR_0201  [0201]
R12401  10K  RESISTOR_0201  [0201]
R12402  10K  RESISTOR_0201  [0201]
R12403  10K  RESISTOR_0201  [0201]
R12404  10K  RESISTOR_0201  [0201]
R12405  10K  RESISTOR_0201  [0201]
R12406  10K  RESISTOR_0201  [0201]
R12407  10K  RESISTOR_0201  [0201]
R12408  10K  RESISTOR_0201  [0201]
R12409  10K  RESISTOR_0201  [0201]
R12410  10K  RESISTOR_0201  [0201]
R12411  10K  RESISTOR_0201  [0201]
R12412  10K  RESISTOR_0201  [0201]
R12413  10K  RESISTOR_0201  [0201]
R12414  10K  RESISTOR_0201  [0201]
R12415  10K  RESISTOR_0201  [0201]
R12416  10K  RESISTOR_0201  [0201]
R12417  10K  RESISTOR_0201  [0201]
R12418  10K  RESISTOR_0201  [0201]
R12419  10K  RESISTOR_0201  [0201]
R12420  10K  RESISTOR_0201  [0201]
R12421  10K  RESISTOR_0201  [0201]
R12422  10K  RESISTOR_0201  [0201]
R12423  10K  RESISTOR_0201  [0201]
R12424  10K  RESISTOR_0201  [0201]
R12425  10K  RESISTOR_0201  [0201]
R12426  10K  RESISTOR_0201  [0201]
R12427  10K  RESISTOR_0201  [0201]
R12428  10K  RESISTOR_0201  [0201]
R12429  10K  RESISTOR_0201  [0201]
R12430  10K  RESISTOR_0201  [0201]
R12431  10K  RESISTOR_0201  [0201]
R12432  10K  RESISTOR_0201  [0201]
R12433  10K  RESISTOR_0201  [0201]
R12434  10K  RESISTOR_0201  [0201]
R12435  10K  RESISTOR_0201  [0201]
R12436  10K  RESISTOR_0201  [0201]
R12437  10K  RESISTOR_0201  [0201]
R12438  10K  RESISTOR_0201  [0201]
R12439  10K  RESISTOR_0201  [0201]
R12440  10K  RESISTOR_0201  [0201]
R12441  10K  RESISTOR_0201  [0201]
R12442  10K  RESISTOR_0201  [0201]
R12443  10K  RESISTOR_0201  [0201]
R12444  10K  RESISTOR_0201  [0201]
R12445  10K  RESISTOR_0201  [0201]
R12446  10K  RESISTOR_0201  [0201]
R12447  10K  RESISTOR_0201  [0201]
R12448  10K  RESISTOR_0201  [0201]
R12449  10K  RESISTOR_0201  [0201]
R12450  10K  RESISTOR_0201  [0201]
R12451  10K  RESISTOR_0201  [0201]
R12452  10K  RESISTOR_0201  [0201]
R12453  10K  RESISTOR_0201  [0201]
R12454  10K  RESISTOR_0201  [0201]
R12455  10K  RESISTOR_0201  [0201]
R12456  10K  RESISTOR_0201  [0201]
R12457  10K  RESISTOR_0201  [0201]
R12458  10K  RESISTOR_0201  [0201]
R12459  10K  RESISTOR_0201  [0201]
R12460  10K  RESISTOR_0201  [0201]
R12461  10K  RESISTOR_0201  [0201]
R12462  10K  RESISTOR_0201  [0201]
R12463  10K  RESISTOR_0201  [0201]
R12464  10K  RESISTOR_0201  [0201]
R12465  10K  RESISTOR_0201  [0201]
R12466  10K  RESISTOR_0201  [0201]
R12467  10K  RESISTOR_0201  [0201]
R12468  10K  RESISTOR_0201  [0201]
R12469  10K  RESISTOR_0201  [0201]
R12470  10K  RESISTOR_0201  [0201]
R12471  10K  RESISTOR_0201  [0201]
R12472  10K  RESISTOR_0201  [0201]
R12473  10K  RESISTOR_0201  [0201]
R12474  10K  RESISTOR_0201  [0201]
R12475  10K  RESISTOR_0201  [0201]
R12476  10K  RESISTOR_0201  [0201]
R12477  10K  RESISTOR_0201  [0201]
R12478  10K  RESISTOR_0201  [0201]
R12479  10K  RESISTOR_0201  [0201]
R12480  10K  RESISTOR_0201  [0201]
R12481  10K  RESISTOR_0201  [0201]
R12482  10K  RESISTOR_0201  [0201]
R12483  10K  RESISTOR_0201  [0201]
R12484  10K  RESISTOR_0201  [0201]
R12485  10K  RESISTOR_0201  [0201]
R12486  10K  RESISTOR_0201  [0201]
R12487  10K  RESISTOR_0201  [0201]
R12488  10K  RESISTOR_0201  [0201]
R12489  10K  RESISTOR_0201  [0201]
R12490  10K  RESISTOR_0201  [0201]
R12491  10K  RESISTOR_0201  [0201]
R12492  10K  RESISTOR_0201  [0201]
R12493  10K  RESISTOR_0201  [0201]
R12494  10K  RESISTOR_0201  [0201]
R12495  10K  RESISTOR_0201  [0201]
R12496  10K  RESISTOR_0201  [0201]
R12497  10K  RESISTOR_0201  [0201]
R12498  10K  RESISTOR_0201  [0201]
R12499  10K  RESISTOR_0201  [0201]
R12500  10K  RESISTOR_0201  [0201]
R12501  10K  RESISTOR_0201  [0201]
R12502  10K  RESISTOR_0201  [0201]
R12503  10K  RESISTOR_0201  [0201]
R12504  10K  RESISTOR_0201  [0201]
R12505  10K  RESISTOR_0201  [0201]
R12506  10K  RESISTOR_0201  [0201]
R12507  10K  RESISTOR_0201  [0201]
R12508  10K  RESISTOR_0201  [0201]
R12509  10K  RESISTOR_0201  [0201]
R12510  10K  RESISTOR_0201  [0201]
R12511  10K  RESISTOR_0201  [0201]
R12512  10K  RESISTOR_0201  [0201]
R12513  10K  RESISTOR_0201  [0201]
R12514  10K  RESISTOR_0201  [0201]
R12515  10K  RESISTOR_0201  [0201]
R12516  10K  RESISTOR_0201  [0201]
R12517  10K  RESISTOR_0201  [0201]
R12518  10K  RESISTOR_0201  [0201]
R12519  10K  RESISTOR_0201  [0201]
R12520  10K  RESISTOR_0201  [0201]
R12521  10K  RESISTOR_0201  [0201]
R12522  10K  RESISTOR_0201  [0201]
R12523  10K  RESISTOR_0201  [0201]
R12524  10K  RESISTOR_0201  [0201]
R12525  10K  RESISTOR_0201  [0201]
R12526  10K  RESISTOR_0201  [0201]
R12527  10K  RESISTOR_0201  [0201]
R12528  10K  RESISTOR_0201  [0201]
R12529  10K  RESISTOR_0201  [0201]
R12530  10K  RESISTOR_0201  [0201]
R12531  10K  RESISTOR_0201  [0201]
R12532  10K  RESISTOR_0201  [0201]
R12533  10K  RESISTOR_0201  [0201]
R12534  10K  RESISTOR_0201  [0201]
R12535  10K  RESISTOR_0201  [0201]
R12536  10K  RESISTOR_0201  [0201]
R12537  10K  RESISTOR_0201  [0201]
R12538  10K  RESISTOR_0201  [0201]
R12539  10K  RESISTOR_0201  [0201]
R12540  10K  RESISTOR_0201  [0201]
R12541  10K  RESISTOR_0201  [0201]
R12542  10K  RESISTOR_0201  [0201]
R12543  10K  RESISTOR_0201  [0201]
R12544  10K  RESISTOR_0201  [0201]
R12545  10K  RESISTOR_0201  [0201]
R12546  10K  RESISTOR_0201  [0201]
R12547  10K  RESISTOR_0201  [0201]
R12548  10K  RESISTOR_0201  [0201]
R12549  10K  RESISTOR_0201  [0201]
R12550  10K  RESISTOR_0201  [0201]
R12551  10K  RESISTOR_0201  [0201]
R12552  10K  RESISTOR_0201  [0201]
R12553  10K  RESISTOR_0201  [0201]
R12554  10K  RESISTOR_0201  [0201]
R12555  10K  RESISTOR_0201  [0201]
R12556  10K  RESISTOR_0201  [0201]
R12557  10K  RESISTOR_0201  [0201]
R12558  10K  RESISTOR_0201  [0201]
R12559  10K  RESISTOR_0201  [0201]
R12560  10K  RESISTOR_0201  [0201]
R12561  10K  RESISTOR_0201  [0201]
R12562  10K  RESISTOR_0201  [0201]
R12563  10K  RESISTOR_0201  [0201]
R12564  10K  RESISTOR_0201  [0201]
R12565  10K  RESISTOR_0201  [0201]
R12566  10K  RESISTOR_0201  [0201]
R12567  10K  RESISTOR_0201  [0201]
R12568  10K  RESISTOR_0201  [0201]
R12569  10K  RESISTOR_0201  [0201]
R12570  10K  RESISTOR_0201  [0201]
R12571  10K  RESISTOR_0201  [0201]
R12572  10K  RESISTOR_0201  [0201]
R12573  10K  RESISTOR_0201  [0201]
R12574  10K  RESISTOR_0201  [0201]
R12575  10K  RESISTOR_0201  [0201]
R12576  10K  RESISTOR_0201  [0201]
R12577  10K  RESISTOR_0201  [0201]
R12578  10K  RESISTOR_0201  [0201]
R12579  10K  RESISTOR_0201  [0201]
R12580  10K  RESISTOR_0201  [0201]
R12581  10K  RESISTOR_0201  [0201]
R12582  10K  RESISTOR_0201  [0201]
R12583  10K  RESISTOR_0201  [0201]
R12584  10K  RESISTOR_0201  [0201]
R12585  10K  RESISTOR_0201  [0201]
R12586  10K  RESISTOR_0201  [0201]
R12587  10K  RESISTOR_0201  [0201]
R12588  10K  RESISTOR_0201  [0201]
R12589  10K  RESISTOR_0201  [0201]
R12590  10K  RESISTOR_0201  [0201]
R12591  10K  RESISTOR_0201  [0201]
R12592  10K  RESISTOR_0201  [0201]
R12593  10K  RESISTOR_0201  [0201]
R12594  10K  RESISTOR_0201  [0201]
R12595  10K  RESISTOR_0201  [0201]
R12596  10K  RESISTOR_0201  [0201]
R12597  10K  RESISTOR_0201  [0201]
R12598  10K  RESISTOR_0201  [0201]
R12599  10K  RESISTOR_0201  [0201]
R12600  10K  RESISTOR_0201  [0201]
R12601  10K  RESISTOR_0201  [0201]
R12602  10K  RESISTOR_0201  [0201]
R12603  10K  RESISTOR_0201  [0201]
R12604  10K  RESISTOR_0201  [0201]
R12605  10K  RESISTOR_0201  [0201]
R12606  10K  RESISTOR_0201  [0201]
R12607  10K  RESISTOR_0201  [0201]
R12608  10K  RESISTOR_0201  [0201]
R12609  10K  RESISTOR_0201  [0201]
R12610  10K  RESISTOR_0201  [0201]
R12611  10K  RESISTOR_0201  [0201]
R12612  10K  RESISTOR_0201  [0201]
R12613  10K  RESISTOR_0201  [0201]
R12614  10K  RESISTOR_0201  [0201]
R12615  10K  RESISTOR_0201  [0201]
R12616  10K  RESISTOR_0201  [0201]
R12617  10K  RESISTOR_0201  [0201]
R12618  10K  RESISTOR_0201  [0201]
R12619  10K  RESISTOR_0201  [0201]
R12620  10K  RESISTOR_0201  [0201]
R12621  10K  RESISTOR_0201  [0201]
R12622  10K  RESISTOR_0201  [0201]
R12623  10K  RESISTOR_0201  [0201]
R12624  10K  RESISTOR_0201  [0201]
R12625  10K  RESISTOR_0201  [0201]
R12626  10K  RESISTOR_0201  [0201]
R12627  10K  RESISTOR_0201  [0201]
R12628  10K  RESISTOR_0201  [0201]
R12629  10K  RESISTOR_0201  [0201]
R12630  10K  RESISTOR_0201  [0201]
R12631  10K  RESISTOR_0201  [0201]
R12632  10K  RESISTOR_0201  [0201]
R12633  10K  RESISTOR_0201  [0201]
R12634  10K  RESISTOR_0201  [0201]
R12635  10K  RESISTOR_0201  [0201]
R12636  10K  RESISTOR_0201  [0201]
R12637  10K  RESISTOR_0201  [0201]
R12638  10K  RESISTOR_0201  [0201]
R12639  10K  RESISTOR_0201  [0201]
R12640  10K  RESISTOR_0201  [0201]
R12641  10K  RESISTOR_0201  [0201]
R12642  10K  RESISTOR_0201  [0201]
R12643  10K  RESISTOR_0201  [0201]
R12644  10K  RESISTOR_0201  [0201]
R12645  10K  RESISTOR_0201  [0201]
R12646  10K  RESISTOR_0201  [0201]
R12647  10K  RESISTOR_0201  [0201]
R12648  10K  RESISTOR_0201  [0201]
R12649  10K  RESISTOR_0201  [0201]
R12650  10K  RESISTOR_0201  [0201]
R12651  10K  RESISTOR_0201  [0201]
R12652  10K  RESISTOR_0201  [0201]
R12653  10K  RESISTOR_0201  [0201]
R12654  10K  RESISTOR_0201  [0201]
R12655  10K  RESISTOR_0201  [0201]
R12656  10K  RESISTOR_0201  [0201]
R12657  10K  RESISTOR_0201  [0201]
R12658  10K  RESISTOR_0201  [0201]
R12659  10K  RESISTOR_0201  [0201]
R12660  10K  RESISTOR_0201  [0201]
R12661  10K  RESISTOR_0201  [0201]
R12662  10K  RESISTOR_0201  [0201]
R12663  10K  RESISTOR_0201  [0201]
R12664  10K  RESISTOR_0201  [0201]
R12665  10K  RESISTOR_0201  [0201]
R12666  10K  RESISTOR_0201  [0201]
R12667  10K  RESISTOR_0201  [0201]
R12668  10K  RESISTOR_0201  [0201]
R12669  10K  RESISTOR_0201  [0201]
R12670  10K  RESISTOR_0201  [0201]
R12671  10K  RESISTOR_0201  [0201]
R12672  10K  RESISTOR_0201  [0201]
R12673  10K  RESISTOR_0201  [0201]
R12674  10K  RESISTOR_0201  [0201]
R12675  10K  RESISTOR_0201  [0201]
R12676  10K  RESISTOR_0201  [0201]
R12677  10K  RESISTOR_0201  [0201]
R12678  10K  RESISTOR_0201  [0201]
R12679  10K  RESISTOR_0201  [0201]
R12680  10K  RESISTOR_0201  [0201]
R12681  10K  RESISTOR_0201  [0201]
R12682  10K  RESISTOR_0201  [0201]
R12683  10K  RESISTOR_0201  [0201]
R12684  10K  RESISTOR_0201  [0201]
R12685  10K  RESISTOR_0201  [0201]
R12686  10K  RESISTOR_0201  [0201]
R12687  10K  RESISTOR_0201  [0201]
R12688  10K  RESISTOR_0201  [0201]
R12689  10K  RESISTOR_0201  [0201]
R12690  10K  RESISTOR_0201  [0201]
R12691  10K  RESISTOR_0201  [0201]
R12692  10K  RESISTOR_0201  [0201]
R12693  10K  RESISTOR_0201  [0201]
R12694  10K  RESISTOR_0201  [0201]
R12695  10K  RESISTOR_0201  [0201]
R12696  10K  RESISTOR_0201  [0201]
R12697  10K  RESISTOR_0201  [0201]
R12698  10K  RESISTOR_0201  [0201]
R12699  10K  RESISTOR_0201  [0201]
R12700  10K  RESISTOR_0201  [0201]
R12701  10K  RESISTOR_0201  [0201]
R12702  10K  RESISTOR_0201  [0201]
R12703  10K  RESISTOR_0201  [0201]
R12704  10K  RESISTOR_0201  [0201]
R12705  10K  RESISTOR_0201  [0201]
R12706  10K  RESISTOR_0201  [0201]
R12707  10K  RESISTOR_0201  [0201]
R12708  10K  RESISTOR_0201  [0201]
R12709  10K  RESISTOR_0201  [0201]
R12710  10K  RESISTOR_0201  [0201]
R12711  10K  RESISTOR_0201  [0201]
R12712  10K  RESISTOR_0201  [0201]
R12713  10K  RESISTOR_0201  [0201]
R12714  10K  RESISTOR_0201  [0201]
R12715  10K  RESISTOR_0201  [0201]
R12716  10K  RESISTOR_0201  [0201]
R12717  10K  RESISTOR_0201  [0201]
R12718  10K  RESISTOR_0201  [0201]
R12719  10K  RESISTOR_0201  [0201]
R12720  10K  RESISTOR_0201  [0201]
R12721  10K  RESISTOR_0201  [0201]
R12722  10K  RESISTOR_0201  [0201]
R12723  10K  RESISTOR_0201  [0201]
R12724  10K  RESISTOR_0201  [0201]
R12725  10K  RESISTOR_0201  [0201]
R12726  10K  RESISTOR_0201  [0201]
R12727  10K  RESISTOR_0201  [0201]
R12728  10K  RESISTOR_0201  [0201]
R12729  10K  RESISTOR_0201  [0201]
R12730  10K  RESISTOR_0201  [0201]
R12731  10K  RESISTOR_0201  [0201]
R12732  10K  RESISTOR_0201  [0201]
R12733  10K  RESISTOR_0201  [0201]
R12734  10K  RESISTOR_0201  [0201]
R12735  10K  RESISTOR_0201  [0201]
R12736  10K  RESISTOR_0201  [0201]
R12737  10K  RESISTOR_0201  [0201]
R12738  10K  RESISTOR_0201  [0201]
R12739  10K  RESISTOR_0201  [0201]
R12740  10K  RESISTOR_0201  [0201]
R12741  10K  RESISTOR_0201  [0201]
R12742  10K  RESISTOR_0201  [0201]
R12743  10K  RESISTOR_0201  [0201]
R12744  10K  RESISTOR_0201  [0201]
R12745  10K  RESISTOR_0201  [0201]
R12746  10K  RESISTOR_0201  [0201]
R12747  10K  RESISTOR_0201  [0201]
R12748  10K  RESISTOR_0201  [0201]
R12749  10K  RESISTOR_0201  [0201]
R12750  10K  RESISTOR_0201  [0201]
R12751  10K  RESISTOR_0201  [0201]
R12752  10K  RESISTOR_0201  [0201]
R12753  10K  RESISTOR_0201  [0201]
R12754  10K  RESISTOR_0201  [0201]
R12755  10K  RESISTOR_0201  [0201]
R12756  10K  RESISTOR_0201  [0201]
R12757  10K  RESISTOR_0201  [0201]
R12758  10K  RESISTOR_0201  [0201]
R12759  10K  RESISTOR_0201  [0201]
R12760  10K  RESISTOR_0201  [0201]
R12761  10K  RESISTOR_0201  [0201]
R12762  10K  RESISTOR_0201  [0201]
R12763  10K  RESISTOR_0201  [0201]
R12764  10K  RESISTOR_0201  [0201]
R12765  10K  RESISTOR_0201  [0201]
R12766  10K  RESISTOR_0201  [0201]
R12767  10K  RESISTOR_0201  [0201]
R12768  10K  RESISTOR_0201  [0201]
R12769  10K  RESISTOR_0201  [0201]
R12770  10K  RESISTOR_0201  [0201]
R12771  10K  RESISTOR_0201  [0201]
R12772  10K  RESISTOR_0201  [0201]
R12773  10K  RESISTOR_0201  [0201]
R12774  10K  RESISTOR_0201  [0201]
R12775  10K  RESISTOR_0201  [0201]
R12776  10K  RESISTOR_0201  [0201]
R12777  10K  RESISTOR_0201  [0201]
R12778  10K  RESISTOR_0201  [0201]
R12779  10K  RESISTOR_0201  [0201]
R12780  10K  RESISTOR_0201  [0201]
R12781  10K  RESISTOR_0201  [0201]
R12782  10K  RESISTOR_0201  [0201]
R12783  10K  RESISTOR_0201  [0201]
R12784  10K  RESISTOR_0201  [0201]
R12785  10K  RESISTOR_0201  [0201]
R12786  10K  RESISTOR_0201  [0201]
R12787  10K  RESISTOR_0201  [0201]
R12788  10K  RESISTOR_0201  [0201]
R12789  10K  RESISTOR_0201  [0201]
R12790  10K  RESISTOR_0201  [0201]
R12791  10K  RESISTOR_0201  [0201]
R12792  10K  RESISTOR_0201  [0201]
R12793  10K  RESISTOR_0201  [0201]
R12794  10K  RESISTOR_0201  [0201]
R12795  10K  RESISTOR_0201  [0201]
R12796  10K  RESISTOR_0201  [0201]
R12797  10K  RESISTOR_0201  [0201]
R12798  10K  RESISTOR_0201  [0201]
R12799  10K  RESISTOR_0201  [0201]
R12800  10K  RESISTOR_0201  [0201]
R12801  10K  RESISTOR_0201  [0201]
R12802  10K  RESISTOR_0201  [0201]
R12803  10K  RESISTOR_0201  [0201]
R12804  10K  RESISTOR_0201  [0201]
R12805  10K  RESISTOR_0201  [0201]
R12806  10K  RESISTOR_0201  [0201]
R12807  10K  RESISTOR_0201  [0201]
R12808  10K  RESISTOR_0201  [0201]
R12809  10K  RESISTOR_0201  [0201]
R12810  10K  RESISTOR_0201  [0201]
R12811  10K  RESISTOR_0201  [0201]
R12812  10K  RESISTOR_0201  [0201]
R12813  10K  RESISTOR_0201  [0201]
R12814  10K  RESISTOR_0201  [0201]
R12815  10K  RESISTOR_0201  [0201]
R12816  10K  RESISTOR_0201  [0201]
R12817  10K  RESISTOR_0201  [0201]
R12818  10K  RESISTOR_0201  [0201]
R12819  10K  RESISTOR_0201  [0201]
R12820  10K  RESISTOR_0201  [0201]
R12821  10K  RESISTOR_0201  [0201]
R12822  10K  RESISTOR_0201  [0201]
R12823  10K  RESISTOR_0201  [0201]
R12824  10K  RESISTOR_0201  [0201]
R12825  10K  RESISTOR_0201  [0201]
R12826  10K  RESISTOR_0201  [0201]
R12827  10K  RESISTOR_0201  [0201]
R12828  10K  RESISTOR_0201  [0201]
R12829  10K  RESISTOR_0201  [0201]
R12830  10K  RESISTOR_0201  [0201]
R12831  10K  RESISTOR_0201  [0201]
R12832  10K  RESISTOR_0201  [0201]
R12833  10K  RESISTOR_0201  [0201]
R12834  10K  RESISTOR_0201  [0201]
R12835  10K  RESISTOR_0201  [0201]
R12836  10K  RESISTOR_0201  [0201]
R12837  10K  RESISTOR_0201  [0201]
R12838  10K  RESISTOR_0201  [0201]
R12839  10K  RESISTOR_0201  [0201]
R12840  10K  RESISTOR_0201  [0201]
R12841  10K  RESISTOR_0201  [0201]
R12842  10K  RESISTOR_0201  [0201]
R12843  10K  RESISTOR_0201  [0201]
R12844  10K  RESISTOR_0201  [0201]
R12845  10K  RESISTOR_0201  [0201]
R12846  10K  RESISTOR_0201  [0201]
R12847  10K  RESISTOR_0201  [0201]
R12848  10K  RESISTOR_0201  [0201]
R12849  10K  RESISTOR_0201  [0201]
R12850  10K  RESISTOR_0201  [0201]
R12851  10K  RESISTOR_0201  [0201]
R12852  10K  RESISTOR_0201  [0201]
R12853  10K  RESISTOR_0201  [0201]
R12854  10K  RESISTOR_0201  [0201]
R12855  10K  RESISTOR_0201  [0201]
R12856  10K  RESISTOR_0201  [0201]
R12857  10K  RESISTOR_0201  [0201]
R12858  10K  RESISTOR_0201  [0201]
R12859  10K  RESISTOR_0201  [0201]
R12860  10K  RESISTOR_0201  [0201]
R12861  10K  RESISTOR_0201  [0201]
R12862  10K  RESISTOR_0201  [0201]
R12863  10K  RESISTOR_0201  [0201]
R12864  10K  RESISTOR_0201  [0201]
R12865  10K  RESISTOR_0201  [0201]
R12866  10K  RESISTOR_0201  [0201]
R12867  10K  RESISTOR_0201  [0201]
R12868  10K  RESISTOR_0201  [0201]
R12869  10K  RESISTOR_0201  [0201]
R12870  10K  RESISTOR_0201  [0201]
R12871  10K  RESISTOR_0201  [0201]
R12872  10K  RESISTOR_0201  [0201]
R12873  10K  RESISTOR_0201  [0201]
R12874  10K  RESISTOR_0201  [0201]
R12875  10K  RESISTOR_0201  [0201]
R12876  10K  RESISTOR_0201  [0201]
R12877  10K  RESISTOR_0201  [0201]
R12878  10K  RESISTOR_0201  [0201]
R12879  10K  RESISTOR_0201  [0201]
R12880  10K  RESISTOR_0201  [0201]
R12881  10K  RESISTOR_0201  [0201]
R12882  10K  RESISTOR_0201  [0201]
R12883  10K  RESISTOR_0201  [0201]
R12884  10K  RESISTOR_0201  [0201]
R12885  10K  RESISTOR_0201  [0201]
R12886  10K  RESISTOR_0201  [0201]
R12887  10K  RESISTOR_0201  [0201]
R12888  10K  RESISTOR_0201  [0201]
R12889  10K  RESISTOR_0201  [0201]
R12890  10K  RESISTOR_0201  [0201]
R12891  10K  RESISTOR_0201  [0201]
R12892  10K  RESISTOR_0201  [0201]
R12893  10K  RESISTOR_0201  [0201]
R12894  10K  RESISTOR_0201  [0201]
R12895  10K  RESISTOR_0201  [0201]
R12896  10K  RESISTOR_0201  [0201]
R12897  10K  RESISTOR_0201  [0201]
R12898  10K  RESISTOR_0201  [0201]
R12899  10K  RESISTOR_0201  [0201]
R12900  10K  RESISTOR_0201  [0201]
R12901  10K  RESISTOR_0201  [0201]
R12902  10K  RESISTOR_0201  [0201]
R12903  10K  RESISTOR_0201  [0201]
R12904  10K  RESISTOR_0201  [0201]
R12905  10K  RESISTOR_0201  [0201]
R12906  10K  RESISTOR_0201  [0201]
R12907  10K  RESISTOR_0201  [0201]
R12908  10K  RESISTOR_0201  [0201]
R12909  10K  RESISTOR_0201  [0201]
R12910  10K  RESISTOR_0201  [0201]
R12911  10K  RESISTOR_0201  [0201]
R12912  10K  RESISTOR_0201  [0201]
R12913  10K  RESISTOR_0201  [0201]
R12914  10K  RESISTOR_0201  [0201]
R12915  10K  RESISTOR_0201  [0201]
R12916  10K  RESISTOR_0201  [0201]
R12917  10K  RESISTOR_0201  [0201]
R12918  10K  RESISTOR_0201  [0201]
R12919  10K  RESISTOR_0201  [0201]
R12920  10K  RESISTOR_0201  [0201]
R12921  10K  RESISTOR_0201  [0201]
R12922  10K  RESISTOR_0201  [0201]
R12923  10K  RESISTOR_0201  [0201]
R12924  10K  RESISTOR_0201  [0201]
R12925  10K  RESISTOR_0201  [0201]
R12926  10K  RESISTOR_0201  [0201]
R12927  10K  RESISTOR_0201  [0201]
R12928  10K  RESISTOR_0201  [0201]
R12929  10K  RESISTOR_0201  [0201]
R12930  10K  RESISTOR_0201  [0201]
R12931  10K  RESISTOR_0201  [0201]
R12932  10K  RESISTOR_0201  [0201]
R12933  10K  RESISTOR_0201  [0201]
R12934  10K  RESISTOR_0201  [0201]
R12935  10K  RESISTOR_0201  [0201]
R12936  10K  RESISTOR_0201  [0201]
R12937  10K  RESISTOR_0201  [0201]
R12938  10K  RESISTOR_0201  [0201]
R12939  10K  RESISTOR_0201  [0201]
R12940  10K  RESISTOR_0201  [0201]
R12941  10K  RESISTOR_0201  [0201]
R12942  10K  RESISTOR_0201  [0201]
R12943  10K  RESISTOR_0201  [0201]
R12944  10K  RESISTOR_0201  [0201]
R12945  10K  RESISTOR_0201  [0201]
R12946  10K  RESISTOR_0201  [0201]
R12947  10K  RESISTOR_0201  [0201]
R12948  10K  RESISTOR_0201  [0201]
R12949  10K  RESISTOR_0201  [0201]
R12950  10K  RESISTOR_0201  [0201]
R12951  10K  RESISTOR_0201  [0201]
R12952  10K  RESISTOR_0201  [0201]
R12953  10K  RESISTOR_0201  [0201]
R12954  10K  RESISTOR_0201  [0201]
R12955  10K  RESISTOR_0201  [0201]
R12956  10K  RESISTOR_0201  [0201]
R12957  10K  RESISTOR_0201  [0201]
R12958  10K  RESISTOR_0201  [0201]
R12959  10K  RESISTOR_0201  [0201]
R12960  10K  RESISTOR_0201  [0201]
R12961  10K  RESISTOR_0201  [0201]
R12962  10K  RESISTOR_0201  [0201]
R12963  10K  RESISTOR_0201  [0201]
R12964  10K  RESISTOR_0201  [0201]
R12965  10K  RESISTOR_0201  [0201]
R12966  10K  RESISTOR_0201  [0201]
R12967  10K  RESISTOR_0201  [0201]
R12968  10K  RESISTOR_0201  [0201]
R12969  10K  RESISTOR_0201  [0201]
R12970  10K  RESISTOR_0201  [0201]
R12971  10K  RESISTOR_0201  [0201]
R12972  10K  RESISTOR_0201  [0201]
R12973  10K  RESISTOR_0201  [0201]
R12974  10K  RESISTOR_0201  [0201]
R12975  10K  RESISTOR_0201  [0201]
R12976  10K  RESISTOR_0201  [0201]
R12977  10K  RESISTOR_0201  [0201]
R12978  10K  RESISTOR_0201  [0201]
R12979  10K  RESISTOR_0201  [0201]
R12980  10K  RESISTOR_0201  [0201]
R12981  10K  RESISTOR_0201  [0201]
R12982  10K  RESISTOR_0201  [0201]
R12983  10K  RESISTOR_0201  [0201]
R12984  10K  RESISTOR_0201  [0201]
R12985  10K  RESISTOR_0201  [0201]
R12986  10K  RESISTOR_0201  [0201]
R12987  10K  RESISTOR_0201  [0201]
R12988  10K  RESISTOR_0201  [0201]
R12989  10K  RESISTOR_0201  [0201]
R12990  10K  RESISTOR_0201  [0201]
R12991  10K  RESISTOR_0201  [0201]
R12992  10K  RESISTOR_0201  [0201]
R12993  10K  RESISTOR_0201  [0201]
R12994  10K  RESISTOR_0201  [0201]
R12995  10K  RESISTOR_0201  [0201]
R12996  10K  RESISTOR_0201  [0201]
R12997  10K  RESISTOR_0201  [0201]
R12998  10K  RESISTOR_0201  [0201]
R12999  10K  RESISTOR_0201  [0201]
R13000  10K  RESISTOR_0201  [0201]
R13001  10K  RESISTOR_0201  [0201]
R13002  10K  RESISTOR_0201  [0201]
R13003  10K  RESISTOR_0201  [0201]
R13004  10K  RESISTOR_0201  [0201]
R13005  10K  RESISTOR_0201  [0201]
R13006  10K  RESISTOR_0201  [0201]
R13007  10K  RESISTOR_0201  [0201]
R13008  10K  RESISTOR_0201  [0201]
R13009  10K  RESISTOR_0201  [0201]
R13010  10K  RESISTOR_0201  [0201]
R13011  10K  RESISTOR_0201  [0201]
R13012  10K  RESISTOR_0201  [0201]
R13013  10K  RESISTOR_0201  [0201]
R13014  10K  RESISTOR_0201  [0201]
R13015  10K  RESISTOR_0201  [0201]
R13016  10K  RESISTOR_0201  [0201]
R13017  10K  RESISTOR_0201  [0201]
R13018  10K  RESISTOR_0201  [0201]
R13019  10K  RESISTOR_0201  [0201]
R13020  10K  RESISTOR_0201  [0201]
R13021  10K  RESISTOR_0201  [0201]
R13022  10K  RESISTOR_0201  [0201]
R13023  10K  RESISTOR_0201  [0201]
R13024  10K  RESISTOR_0201  [0201]
R13025  10K  RESISTOR_0201  [0201]
R13026  10K  RESISTOR_0201  [0201]
R13027  10K  RESISTOR_0201  [0201]
R13028  10K  RESISTOR_0201  [0201]
R13029  10K  RESISTOR_0201  [0201]
R13030  10K  RESISTOR_0201  [0201]
R13031  10K  RESISTOR_0201  [0201]
R13032  10K  RESISTOR_0201  [0201]
R13033  10K  RESISTOR_0201  [0201]
R13034  10K  RESISTOR_0201  [0201]
R13035  10K  RESISTOR_0201  [0201]
R13036  10K  RESISTOR_0201  [0201]
R13037  10K  RESISTOR_0201  [0201]
R13038  10K  RESISTOR_0201  [0201]
R13039  10K  RESISTOR_0201  [0201]
R13040  10K  RESISTOR_0201  [0201]
R13041  10K  RESISTOR_0201  [0201]
R13042  10K  RESISTOR_0201  [0201]
R13043  10K  RESISTOR_0201  [0201]
R13044  10K  RESISTOR_0201  [0201]
R13045  10K  RESISTOR_0201  [0201]
R13046  10K  RESISTOR_0201  [0201]
R13047  10K  RESISTOR_0201  [0201]
R13048  10K  RESISTOR_0201  [0201]
R13049  10K  RESISTOR_0201  [0201]
R13050  10K  RESISTOR_0201  [0201]
R13051  10K  RESISTOR_0201  [0201]
R13052  10K  RESISTOR_0201  [0201]
R13053  10K  RESISTOR_0201  [0201]
R13054  10K  RESISTOR_0201  [0201]
R13055  10K  RESISTOR_0201  [0201]
R13056  10K  RESISTOR_0201  [0201]
R13057  10K  RESISTOR_0201  [0201]
R13058  10K  RESISTOR_0201  [0201]
R13059  10K  RESISTOR_0201  [0201]
R13060  10K  RESISTOR_0201  [0201]
R13061  10K  RESISTOR_0201  [0201]
R13062  10K  RESISTOR_0201  [0201]
R13063  10K  RESISTOR_0201  [0201]
R13064  10K  RESISTOR_0201  [0201]
R13065  10K  RESISTOR_0201  [0201]
R13066  10K  RESISTOR_0201  [0201]
R13067  10K  RESISTOR_0201  [0201]
R13068  10K  RESISTOR_0201  [0201]
R13069  10K  RESISTOR_0201  [0201]
R13070  10K  RESISTOR_0201  [0201]
R13071  10K  RESISTOR_0201  [0201]
R13072  10K  RESISTOR_0201  [0201]
R13073  10K  RESISTOR_0201  [0201]
R13074  10K  RESISTOR_0201  [0201]
R13075  10K  RESISTOR_0201  [0201]
R13076  10K  RESISTOR_0201  [0201]
R13077  10K  RESISTOR_0201  [0201]